# EasyEDA Pro project Jarvis.eprj, schematic Schematic5
Board Name: ControlLogic; Create Date: 2026-04-12; Page Name: P1; Project Name: Jarvis; Schematic Name: Schematic5; Update Date: 2026-04-13; Company: EasyEDA.com; Page Size: A4; Version: V1.0
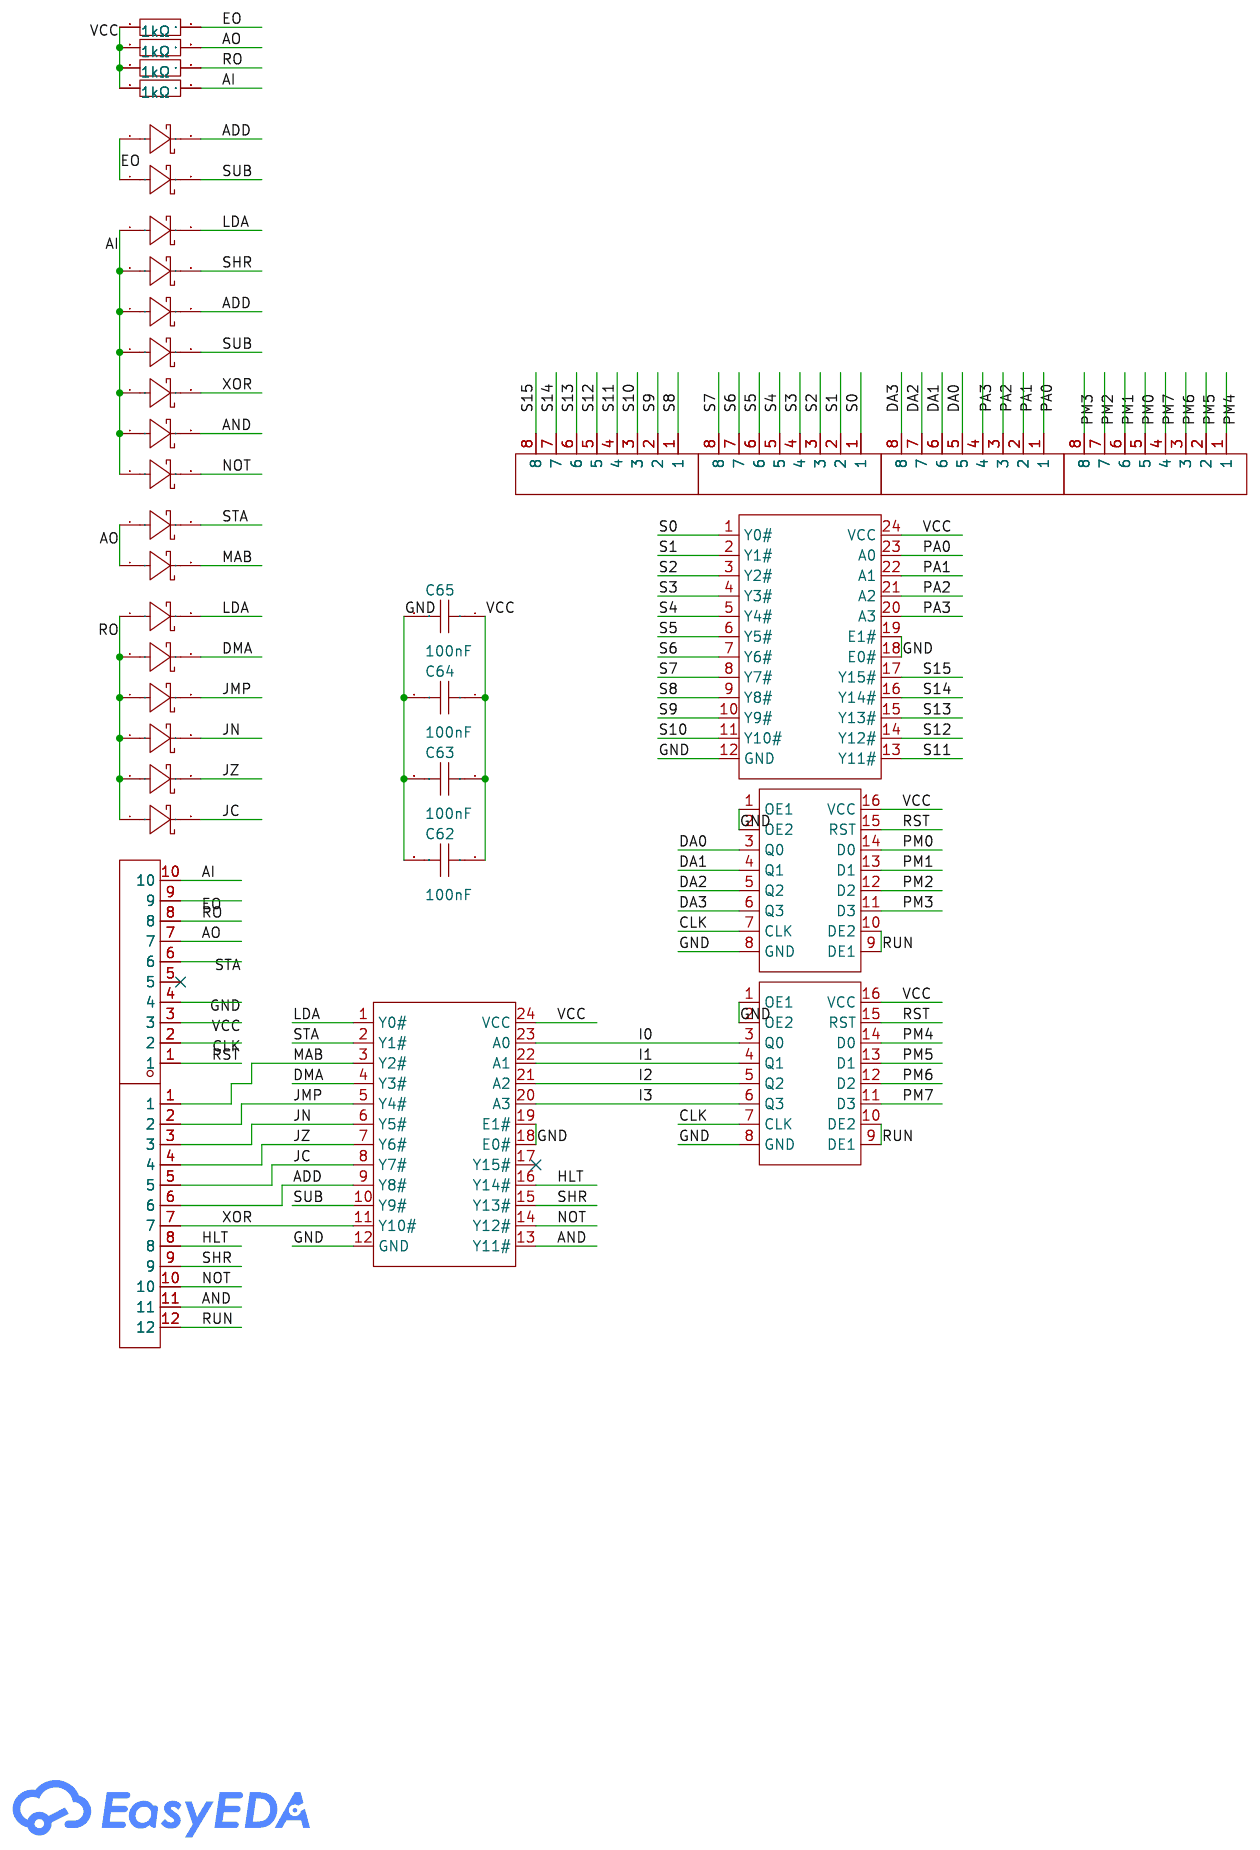
[diagram p2: schematic sheet]

## Parts
C62  100nF  [CAP-TH_L5.0-W2.5-P5.00-D1.0]
C63  100nF  [CAP-TH_L5.0-W2.5-P5.00-D1.0]
C64  100nF  [CAP-TH_L5.0-W2.5-P5.00-D1.0]
C65  100nF  [CAP-TH_L5.0-W2.5-P5.00-D1.0]
R57  1kΩ  [RES-TH_BD2.3-L6.5-P10.50-D0.5]
R58  1kΩ  [RES-TH_BD2.3-L6.5-P10.50-D0.5]
R59  1kΩ  [RES-TH_BD2.3-L6.5-P10.50-D0.5]
R60  1kΩ  [RES-TH_BD2.3-L6.5-P10.50-D0.5]
U1  XD74LS154  [DIP-24_L32.0-W13.8-P2.54-LS15.6-BL]
U2  XD74LS154  [DIP-24_L32.0-W13.8-P2.54-LS15.6-BL]
U6  CD74HC173E  [PDIP-16_L19.2-W6.6-P2.54-LS7.6-BL]
U7  TH2.54_8P_0.6  [HDR-TH_8P-P2.54-V-M-3]
U8  TH2.54_8P_0.6  [HDR-TH_8P-P2.54-V-M-3]
U9  CD74HC173E  [PDIP-16_L19.2-W6.6-P2.54-LS7.6-BL]
U355  1N4007-DIODE  [DO-41_BD2.4-L4.7-P8.70-D0.8-FD]
U388  TH2.54_8P_0.6  [HDR-TH_8P-P2.54-V-M-3]
U390  1N4007-DIODE  [DO-41_BD2.4-L4.7-P8.70-D0.8-FD]
U391  1N4007-DIODE  [DO-41_BD2.4-L4.7-P8.70-D0.8-FD]
U392  1N4007-DIODE  [DO-41_BD2.4-L4.7-P8.70-D0.8-FD]
U393  1N4007-DIODE  [DO-41_BD2.4-L4.7-P8.70-D0.8-FD]
U394  1N4007-DIODE  [DO-41_BD2.4-L4.7-P8.70-D0.8-FD]
U395  1N4007-DIODE  [DO-41_BD2.4-L4.7-P8.70-D0.8-FD]
U396  1N4007-DIODE  [DO-41_BD2.4-L4.7-P8.70-D0.8-FD]
U397  1N4007-DIODE  [DO-41_BD2.4-L4.7-P8.70-D0.8-FD]
U398  1N4007-DIODE  [DO-41_BD2.4-L4.7-P8.70-D0.8-FD]
U399  D22030200553-HDR-TH_12P-P2.54-V-F  [HDR-TH_12P-P2.54-V-F]
U400  TH2.54_8P_0.6  [HDR-TH_8P-P2.54-V-M-3]
U401  1N4007-DIODE  [DO-41_BD2.4-L4.7-P8.70-D0.8-FD]
U402  1N4007-DIODE  [DO-41_BD2.4-L4.7-P8.70-D0.8-FD]
U403  1N4007-DIODE  [DO-41_BD2.4-L4.7-P8.70-D0.8-FD]
U405  1N4007-DIODE  [DO-41_BD2.4-L4.7-P8.70-D0.8-FD]
U406  1N4007-DIODE  [DO-41_BD2.4-L4.7-P8.70-D0.8-FD]
U409  cn10_2r54_10x1  [HDR-TH_10P-P2.54-V-F]
U410  1N4007-DIODE  [DO-41_BD2.4-L4.7-P8.70-D0.8-FD]
U411  1N4007-DIODE  [DO-41_BD2.4-L4.7-P8.70-D0.8-FD]

## Library data of the parts
C62-C65 = 178MU0006: LCSC Part Name: 100nF ±10% 50V; Supplier Part: C5632430; Manufacturer: KNSCHA(科尼盛); Supplier Footprint: 插件,P=2.54mm; JLCPCB Part Class: Extended Part; Datasheet: https://item.szlcsc.com/datasheet/178MU0006/6552585.html; Supplier: LCSC; Tolerance: ±10%; Voltage Rating: 50V; Temperature Coefficient: X7R; Pin Spacing: 2.54mm
R57-R60 = MF1/4W-1KΩ±1%T52: Type:Metal Film Resistors Resistance: Tolerance:±1% Tolerance:±1% Power(Watts):250mW Temperature Coefficient:±200ppm/℃ Temperature Coefficient:±200ppm/℃; LCSC Part Name: 金属膜电阻 1kΩ ±1% 250mW; Supplier Part: C713997; Manufacturer: 华星机电; Supplier Footprint: 插件,D2.3xL6.5mm; JLCPCB Part Class: Extended Part; Datasheet: https://atta.szlcsc.com/upload/public/pdf/source/20200731/C713882_AE8EB1102749D7E4FB4FB13DC898C429.pdf; Supplier: LCSC; Type: Metal Film Resistors; Tolerance: ±1%; Power(Watts): 250mW; Temperature Coefficient: ±200ppm/℃
U1 U2 = XD74LS154: LCSC Part Name: 编码器,解码器,复用器和解复用器; Supplier Part: C707077; Manufacturer: XINLUDA(信路达); Supplier Footprint: DIP-24; JLCPCB Part Class: Extended Part; Datasheet: https://item.szlcsc.com/datasheet/XD74LS154/744199.html; Supplier: LCSC; Type: Decoder; Voltage - Supply: 4.75V~5.25V; Number of lines: 4/16; Current - Output Low(IOL): 8mA; Current - Output High(IOH): 400uA; Operating temperature: 0℃~+70℃; Propagation Delay: 23ns；19ns; Quiescent Current: 9mA
U6 U9 = CD74HC173E: LCSC Part Name: 三态高速CMOS逻辑四路D型触发器; Supplier Part: C1549968; Manufacturer: TI(德州仪器); Supplier Footprint: PDIP-16; JLCPCB Part Class: Extended Part; Datasheet: https://www.ti.com/cn/lit/gpn/cd74hct173; Supplier: LCSC; Type: D-Type; Trigger Type: Rising Edge; Voltage - Supply: 2V~6V; Clock Frequency: 60MHz; Function: Reset; Number of Elements: 1; Number of Bits per Element: 4; Output Type: Tri-State; Propagation Delay: 34ns@6V,50pF; Series: 74HC Series; Current - Output Low(IOL): 7.8mA; Current - Output High(IOH): 7.8mA; Quiescent Current: 8uA; Input Capacitance: 10pF; Operating Temperature: -55℃~+125℃; Setup Time: 12ns; Hold Time: 3ns
U7 U8 U388 U400 = TH2.54_8P_0.6: Supplier Part: C9900018349; Supplier Footprint: HDR-TH-8P; JLCPCB Part Class: Extended Part; Supplier: LCSC
U355 U390-U398 U401-U403 U405 U406 U410 U411 = 1N4007-DIODE: Supplier Part: C9900005663; Supplier Footprint: DO-41; JLCPCB Part Class: Extended Part; Supplier: LCSC
U399 = D22030200553-HDR-TH_12P-P2.54-V-F: Supplier Part: C9900009321; JLCPCB Part Class: Extended Part; Supplier: LCSC
U409 = cn10_2r54_10x1: Supplier Part: C9900001415; JLCPCB Part Class: Extended Part; Supplier: LCSC

## Nets
GND: C62.2 C63.2 C64.2 C65.2 U1.12(GND) U1.18(E0#) U1.19(E1#) U2.12(GND) U2.18(E0#) U2.19(E1#) U6.1(OE1) U6.2(OE2) U6.8(GND) U9.1(OE1) U9.2(OE2) U9.8(GND) U409.4
VCC: C62.1 C63.1 C64.1 C65.1 R57.1 R58.1 R59.1 R60.1 U1.24(VCC) U2.24(VCC) U6.16(VCC) U9.16(VCC) U409.3
ADD: U1.9(Y8#) U399.6 U403.2(K) U406.2(K)
AI: R59.2 U355.1(A) U390.1(A) U401.1(A) U402.1(A) U403.1(A) U409.10 U410.1(A) U411.1(A)
AND: U1.13(Y11#) U390.2(K) U399.11
AO: R57.2 U391.1(A) U392.1(A) U409.7
CLK: U6.7(CLK) U9.7(CLK) U409.2
DA0: U9.3(Q0) U400.5
DA1: U9.4(Q1) U400.6
DA2: U9.5(Q2) U400.7
DA3: U9.6(Q3) U400.8
DMA: U1.4(Y3#) U394.2(K)
EO: R60.2 U405.1(A) U406.1(A) U409.9
HLT: U1.16(Y14#) U399.8
I0: U1.23(A0) U6.3(Q0)
I1: U1.22(A1) U6.4(Q1)
I2: U1.21(A2) U6.5(Q2)
I3: U1.20(A3) U6.6(Q3)
JC: U1.8(Y7#) U398.2(K) U399.5
JMP: U1.5(Y4#) U395.2(K) U399.2
JN: U1.6(Y5#) U396.2(K) U399.3
JZ: U1.7(Y6#) U397.2(K) U399.4
LDA: U1.1(Y0#) U393.2(K) U411.2(K)
MAB: U1.3(Y2#) U392.2(K) U399.1
NOT: U1.14(Y12#) U355.2(K) U399.10
PA0: U2.23(A0) U400.1
PA1: U2.22(A1) U400.2
PA2: U2.21(A2) U400.3
PA3: U2.20(A3) U400.4
PM0: U9.14(D0) U388.5
PM1: U9.13(D1) U388.6
PM2: U9.12(D2) U388.7
PM3: U9.11(D3) U388.8
PM4: U6.14(D0) U388.1
PM5: U6.13(D1) U388.2
PM6: U6.12(D2) U388.3
PM7: U6.11(D3) U388.4
RO: R58.2 U393.1(A) U394.1(A) U395.1(A) U396.1(A) U397.1(A) U398.1(A) U409.8
RST: U6.15(RST) U9.15(RST) U409.1
RUN: U6.9(DE1) U6.10(DE2) U9.9(DE1) U9.10(DE2) U399.12
S0: U2.1(Y0#) U7.1
S1: U2.2(Y1#) U7.2
S2: U2.3(Y2#) U7.3
S3: U2.4(Y3#) U7.4
S4: U2.5(Y4#) U7.5
S5: U2.6(Y5#) U7.6
S6: U2.7(Y6#) U7.7
S7: U2.8(Y7#) U7.8
S8: U2.9(Y8#) U8.1
S9: U2.10(Y9#) U8.2
S10: U2.11(Y10#) U8.3
S11: U2.13(Y11#) U8.4
S12: U2.14(Y12#) U8.5
S13: U2.15(Y13#) U8.6
S14: U2.16(Y14#) U8.7
S15: U2.17(Y15#) U8.8
SHR: U1.15(Y13#) U399.9 U410.2(K)
STA: U1.2(Y1#) U391.2(K) U409.6
SUB: U1.10(Y9#) U402.2(K) U405.2(K)
XOR: U1.11(Y10#) U399.7 U401.2(K)

Not connected (* = marked no-connect by the designer): U1 17(Y15#)*; U409 5*
